# EasyEDA Pro project 电子指南针-git.eprj, board PCB6_2
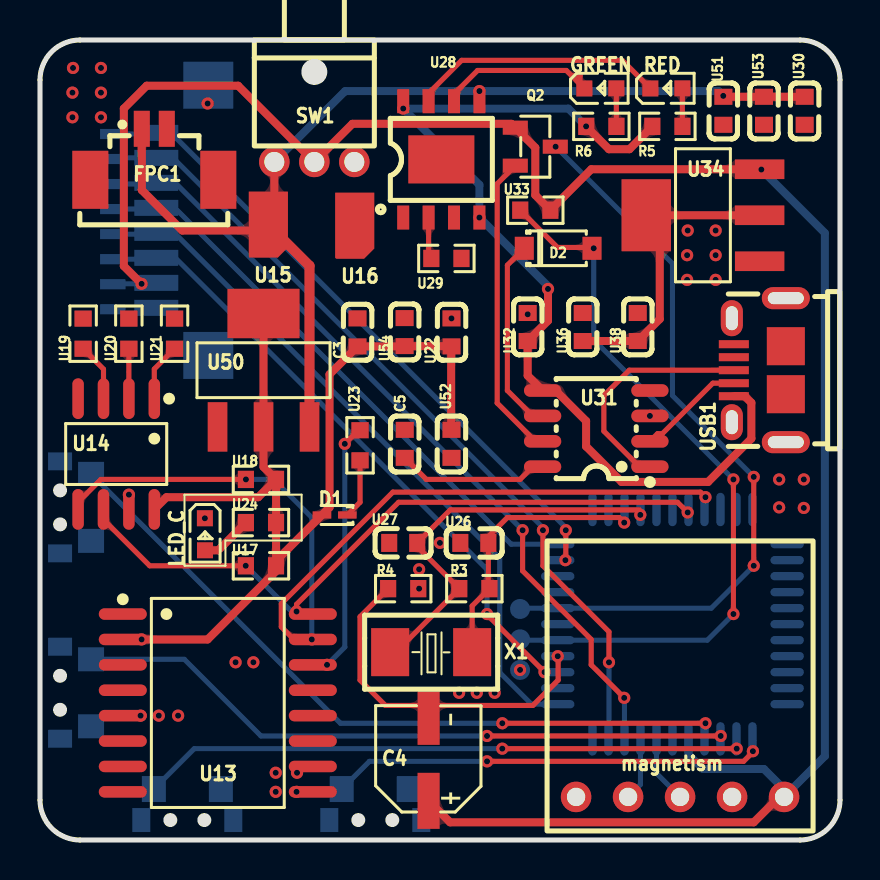
[diagram p4: board, top side]
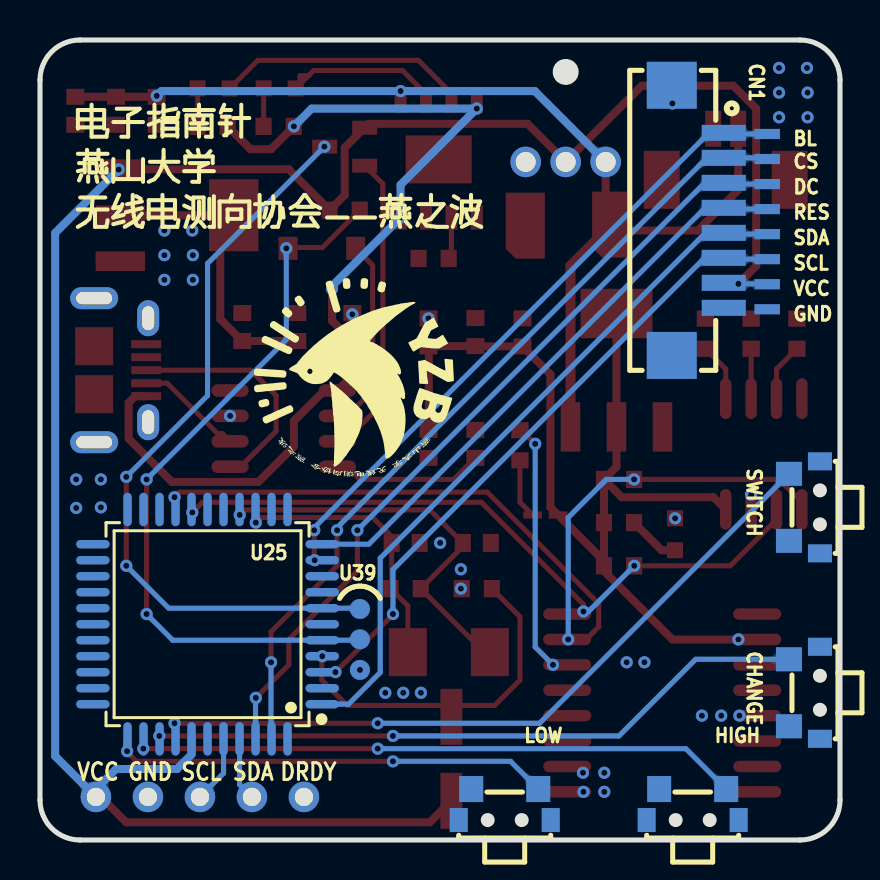
[diagram p5: board, bottom side, seen from below]

Outline 40 x 40 mm; copper layers: Top Layer, Bottom Layer. Coordinates in mm from the lower left corner of the outline.
Outline path: 0,38 0,2 arc(0.59,0.59) 2,0 38,0 arc(39.41,0.59) 40,2 40,38 arc(39.41,39.41) 38,40 2,40 arc(0.59,39.41) 0,38
Stack: Top Layer 0.035mm / Dielectric1 1.51mm FR4 er 4.5 / Bottom Layer 0.035mm

## Design rules (mm)
template: 自定义配置
spacing copperThickness1oz (default): track to track 0.102, other pairs 0.152 to 0.3
spacing copperThickness2oz: track to track 0.203, other pairs 0.152 to 0.3
track width copperThickness1oz (default): min 0.127, default 0.254, max 2.54
track width copperThickness2oz: min 0.203, default 0.254, max 2.54
differential pair differentialPair (default): width min 0.127, default 0.254, max 2.54; gap min 0.152, default 0.152
via viaSize (default): diameter min 0.5, default 0.61, max 10; hole min 0.3, default 0.305, max 6.3
net GND uses copperRegion1

## Placement (name value [footprint] x y rotation side)
BL  -  [mini焊盘]  3.64 35.3 180 bottom
C3  100nF  [C0603]  15.88 25.38 270 top
C4  10uF  [CAP-SMD_BD5.0-L5.3-W5.3-FD]  19.43 4.06 90 top
C5  100nF  [C0603]  18.24 19.81 90 top
CHANGE  TS24CA  [SW-SMD_TS24CA]  1.78 7.36 270 bottom
CN1  HC-1.25-8PWT  [CONN-SMD_HC-1.25-8PWT]  7.11 30.98 270 bottom
CS  -  [mini焊盘]  3.64 34.05 180 bottom
D1  1N4148WT  [SOD-523_L1.2-W0.8-LS1.6-RD]  14.73 16.25 180 top
D2  MBR0520  [SOD-123_L2.8-W1.8-LS3.7-RD]  25.91 29.59 0 top
DC  -  [mini焊盘]  3.64 32.8 180 bottom
FPC1  1.25-2PWB  [CONN-SMD_2P-P1.25_DEALON_1.25-2PWB]  5.72 34.28 0 top
GND  -  [mini焊盘]  3.64 26.54 180 bottom
GREEN  -  [LED_0603]  28.07 37.59 0 top
HIGH  TS24CA  [SW-SMD_TS24CA]  7.37 1.77 0 bottom
LED_C  -  [LED_0603]  8.25 15.23 270 top
LOW  TS24CA  [SW-SMD_TS24CA]  16.76 1.77 0 bottom
magnetism  -  [5插件焊盘 间距2.6mm]  32 2.15 0 top
Q2  2SK3018  [SOT-23-3_L2.9-W1.3-P1.90-LS2.4-BR]  24.76 34.67 180 top
R3  10K  [R0603]  21.72 12.57 0 top
R4  10K  [R0603]  18.16 12.57 180 top
R5  2kΩ  [R0603]  31.37 35.68 180 top
R6  2kΩ  [R0603]  28.07 35.68 180 top
RED  -  [LED_0603]  31.37 37.59 0 top
RES  -  [mini焊盘]  3.64 31.55 180 bottom
SCL  -  [mini焊盘]  3.64 29.04 180 bottom
SDA  -  [mini焊盘]  3.64 30.29 180 bottom
SW1  XKB5858-Z-C  [SW-TH_XKB5858-Z-C]  13.72 33.9 0 top
SWITCH  TS24CA  [SW-SMD_TS24CA]  1.78 16.63 270 bottom
U13  DS3231SN#  [SOIC-16_L10.3-W7.5-P1.27-LS10.3-BL]  8.89 6.85 270 top
U14  AT24C02  [SOP-8_L5.0-W4.0-P1.27-LS6.0-BL]  3.81 19.3 180 top
U15  -  [小焊盘]  11.38 31.15 180 top
U16  -  [小焊盘]  15.7 31.1 180 top
U17  4.7kΩ  [R0603]  11.05 13.71 0 top
U18  4.7kΩ  [R0603]  11.05 18.03 0 top
U19  4.7kΩ  [R0603]  2.16 25.32 90 top
U20  4.7kΩ  [R0603]  4.44 25.32 90 top
U21  4.7kΩ  [R0603]  6.73 25.32 90 top
U22  1uF  [C0603]  20.57 25.38 270 top
U23  200Ω  [R0603]  16 19.74 90 top
U24  1kΩ  [R0603]  11.05 15.87 0 top
U25  STC89C52RC-40I-LQFP44  [LQFP-44_L10.0-W10.0-P0.80-LS12.0-BL]  31.62 10.79 90 bottom
U26  30pF  [C0603]  21.72 14.85 0 top
U27  30pF  [C0603]  18.16 14.85 0 top
U28  TP4056  [ESOP-8_L4.9-W3.9-P1.27-LS6.0-BL-EP]  20.07 34.03 0 top
U29  1.2kΩ  [R0603]  20.32 29.08 180 top
U30  10uF  [C0603]  38.23 36.46 90 top
U31  CH340N  [SOP-8_L4.9-W3.9-P1.27-LS6.0-BL]  27.81 20.57 90 top
U32  10uF  [C0603]  24.38 25.65 270 top
U33  2kΩ  [R0603]  24.76 31.49 0 top
U34  SK12D07VG3  [SOT-223-4_L6.5-W3.5-P2.30-LS7.0-BR]  33.15 31.24 0 top
U36  10uF  [C0603]  27.14 25.65 270 top
U38  1.5pF  [C0603]  29.89 25.65 270 top
U39  -  [下载调试点]  24 11.04 180 bottom
U50  SK12D07VG3  [SOT-223-4_L6.5-W3.5-P2.30-LS7.0-BR]  11.18 23.49 270 top
U51  10uF  [C0603]  34.17 36.46 90 top
U52  10uF  [C0603]  20.57 19.81 90 top
U53  1.5pF  [C0603]  36.2 36.46 90 top
U54  1.5pF  [C0603]  18.23 25.39 270 top
USB1  U254-051N-4BH24-S2S  [MICRO-USB-SMD_U254-051N-4BH24-S2]  35.94 23.49 90 top
VCC  -  [mini焊盘]  3.64 27.79 180 bottom
X1  11.0592MHz  [OSC-SMD_L5.0-W3.2]  19.56 9.39 0 top

## Footprints (pads in the part's own frame, mm; a bottom-side part is the same pattern mirrored in y, then rotated)
5插件焊盘 间距2.6mm
  round 1.524 hole 0.914: 1(-5.2,0) 2(-2.6,0) 3(0,0) 4(2.6,0) 5(5.2,0)
C0603
  rect 0.8x0.9 smd: 1(-0.7,0) 2(0.7,0)
CAP-SMD_BD5.0-L5.3-W5.3-FD
  rect 2.8x1.1 smd: 1(-2.1,0) 2(2.1,0)
CONN-SMD_2P-P1.25_DEALON_1.25-2PWB
  rect 0.8x1.8 smd: 1(-0.625,1.275) 2(0.625,1.275)
  rect 1.8x2.9 smd: 3(-3.2,-1.275) 4(3.2,-1.275)
CONN-SMD_HC-1.25-8PWT
  rect 0.8x2.2 smd: 1(-4.375,1.3) 2(-3.125,1.3) 3(-1.875,1.3) 4(-0.625,1.3) 5(0.625,1.3) 6(1.875,1.3) 7(3.125,1.3) 8(4.375,1.3)
  rect 2.35x2.5 smd: 9(-6.755,-1.3) 10(6.755,-1.3)
ESOP-8_L4.9-W3.9-P1.27-LS6.0-BL-EP
  rect 0.6x1.2 smd: 1(-1.905,-2.909) 2(-0.635,-2.909) 3(0.635,-2.909) 4(1.905,-2.909) 5(1.905,2.909) 6(0.635,2.909) 7(-0.635,2.909) 8(-1.905,2.909)
  rect 3.3x2.4 smd: 9(0,0)
LED_0603
  rect 0.8x0.8 smd: 1(-0.851,-0.01) 2(0.75,-0.005)
LQFP-44_L10.0-W10.0-P0.80-LS12.0-BL
  oval 0.42x1.67 smd: 1(-4,-5.735) 2(-3.2,-5.735) 3(-2.4,-5.735) 4(-1.6,-5.735) 5(-0.8,-5.735) 6(0,-5.735) 7(0.8,-5.735) 8(1.6,-5.735) 9(2.4,-5.735) 10(3.2,-5.735) 11(4,-5.735) 23(4,5.735) 24(3.2,5.735) 25(2.4,5.735) 26(1.6,5.735) 27(0.8,5.735) 28(0,5.735) 29(-0.8,5.735) 30(-1.6,5.735) 31(-2.4,5.735) 32(-3.2,5.735) 33(-4,5.735)
  oval 1.67x0.42 smd: 12(5.735,-4) 13(5.735,-3.2) 14(5.735,-2.4) 15(5.735,-1.6) 16(5.735,-0.8) 17(5.735,0) 18(5.735,0.8) 19(5.735,1.6) 20(5.735,2.4) 21(5.735,3.2) 22(5.735,4) 34(-5.735,4) 35(-5.735,3.2) 36(-5.735,2.4) 37(-5.735,1.6) 38(-5.735,0.8) 39(-5.735,0) 40(-5.735,-0.8) 41(-5.735,-1.6) 42(-5.735,-2.4) 43(-5.735,-3.2) 44(-5.735,-4)
MICRO-USB-SMD_U254-051N-4BH24-S2
  rect 0.4x1.5 smd: 1(-1.3,1.25) 2(-0.65,1.25) 3(0,1.25) 4(0.65,1.25) 5(1.3,1.25)
  oval 1.1x2.4 hole 0.6x1.8: 6(-3.6,-1.35) 6(3.6,-1.35)
  oval 1.8x1.1 hole 1.2x0.6: 6(-2.6,1.35) 6(2.6,1.35)
  rect 1.9x1.9 smd: 6(-1.2,-1.35) 6(1.2,-1.35)
mini焊盘
  custom 1.27x0.508 smd: 1(0,0)
OSC-SMD_L5.0-W3.2
  rect 1.9x2.4 smd: 1(-2.05,0) 2(2.05,0)
R0603
  rect 0.806x0.864 smd: 1(-0.753,0) 2(0.753,0)
SOD-123_L2.8-W1.8-LS3.7-RD
  rect 0.95x1.15 smd: 1(-1.692,0) 2(1.692,0)
SOD-523_L1.2-W0.8-LS1.6-RD
  rect 0.93x0.36 smd: 1(-0.635,0) 2(0.635,0)
SOIC-16_L10.3-W7.5-P1.27-LS10.3-BL
  oval 0.574x2.401 smd: 1(-4.445,-4.75) 2(-3.175,-4.75) 3(-1.905,-4.75) 4(-0.635,-4.75) 5(0.635,-4.75) 6(1.905,-4.75) 7(3.175,-4.75) 8(4.445,-4.75) 9(4.445,4.75) 10(3.175,4.75) 11(1.905,4.75) 12(0.635,4.75) 13(-0.635,4.75) 14(-1.905,4.75) 15(-3.175,4.75) 16(-4.445,4.75)
SOP-8_L4.9-W3.9-P1.27-LS6.0-BL
  oval 0.63x1.865 smd: 1(-1.905,-2.683) 2(-0.635,-2.683) 3(0.635,-2.683) 4(1.905,-2.683) 5(1.905,2.683) 6(0.635,2.683) 7(-0.635,2.683) 8(-1.905,2.683)
SOP-8_L5.0-W4.0-P1.27-LS6.0-BL
  oval 0.574x2.035 smd: 1(-1.905,-2.768) 2(-0.635,-2.768) 3(0.635,-2.768) 4(1.905,-2.768) 5(1.905,2.768) 6(0.635,2.768) 7(-0.635,2.768) 8(-1.905,2.768)
SOT-23-3_L2.9-W1.3-P1.90-LS2.4-BR
  rect 1.25x0.7 smd: 1(1,-0.95) 2(1,0.95) 3(-1,0)
SOT-223-4_L6.5-W3.5-P2.30-LS7.0-BR
  rect 2.47x0.98 smd: 1(2.835,-2.3) 2(2.835,0) 3(2.835,2.3)
  rect 2.47x3.6 smd: 4(-2.835,0)
SW-SMD_TS24CA
  rect 0.9x1.2 smd: 1(-2.3,0.775) 2(2.3,0.775)
  rect 1.2x1.3 smd: 3(-1.675,-0.775) 4(1.675,-0.775)
SW-TH_XKB5858-Z-C
  round 1.524 hole 1: 1(2,0) 2(0,0) 3(-2,0)
下载调试点
  round 1 smd: 1(0,0.508) 2(0,-1.01) 3(0,-2.54)
小焊盘
  custom 1.957x3.302 smd: 1(-0.037,0.381)

## Nets
As in the schematic, except:
3V3: U34.2 U34.4 U36.2 U38.2
GND: C3.1 C5.2 CHANGE.4 CN1.8 CN1.9 CN1.10 FPC1.2 GND.1 HIGH.4 LED_C.1 LOW.4 magnetism.4 R4.1 SWITCH.4 U13.5 U13.6 U13.7 U13.8 U13.9 U13.10 U13.11 U13.12 U13.13 U14.4 U14.7 U16.1 U19.2 U20.2 U21.2 U22.1 U25.16 U26.1 U27.1 U28.1 U28.3 U28.9 U29.1 U30.1 U31.3 U32.1 U34.1 U36.1 U38.1 U39.3 U50.1 U51.1 U52.1 U53.1 U54.1 USB1.5 USB1.6
VCC: C4.1 CN1.7 magnetism.5 Q2.1 SW1.2 U25.38 U33.2 U34.3 VCC.1

Pads without a net: CHANGE 1 2; FPC1 3 4; HIGH 1 2; LOW 1 2; SW1 1; SWITCH 1 2; U13 1 3 4; U25 2 6 8 9 12 13 17 20 21 22 23 24 25 26 27 28 29 30 31 32 33 39 44; U31 4; USB1 4

## Via types
v1: diameter 0.61, hole 0.305, Top Layer to Bottom Layer, 80 vias

## Routing (per net, layer and track width the routed paths; a pad name or vN(x,y) marks a point on that pad's centre or on a via; arc(x,y) is an arc through that point)
3V3: length 15.4
  Top Layer w0.4: U36.2 U38.2 30.99,26.05 30.99,30.56 U34.4 U34.2
3V3_LONG: length 49.3
  Top Layer w0.254: 20.56,24.69 U22.2
  Top Layer w0.4: U50.4 U50.2 11.18,18.66 U18.2 ; 11.8,13.96 D1.2 14.48,16.63 14.48,23.28 C3.2 18.21,24.68 U54.2 20.56,24.69 20.56,20.52 U52.2 ; 11.8,13.96 U24.2 U18.2 ; 11.8,13.96 U17.2 11.8,13.45 8.38,10.03 v1(5.08,10.03) ; U18.2 10.91,17.14 6.32,17.14 U14.8
GND:
  vias: v1(1.65,38.6) v1(1.62,37.37) v1(1.62,36.13) v1(3.05,38.6) v1(3.05,37.37) v1(3.05,36.13) v1(4.44,17.27) v1(5.03,6.22) v1(5.94,6.22) v1(6.91,6.22) v1(8.24,16.09) v1(8.38,36.82) v1(9.78,8.88) v1(10.67,8.88) v1(11.79,3.36) v1(11.79,2.41) v1(12.85,3.36) v1(12.83,2.41) v1(18.96,13.54) v1(18.96,12.57) v1(20,14.86) v1(20.57,26.08) v1(20.95,7.36) v1(21.84,7.36) v1(22.73,7.36) v1(24,8.5) v1(24.38,26.28) v1(30.5,21.2) v1(32.36,29.24) v1(32.36,28.01) v1(32.38,30.47) v1(33.78,30.47) v1(33.78,29.24) v1(33.78,28.01) v1(36.96,18.03) v1(36.96,16.63) v1(38.19,18.03) v1(38.19,16.6)
VCC: length 109
  Top Layer w0.254: v1(36.07,33.52) 36.05,33.54 U34.3
  Top Layer w0.4: v1(5.08,27.81) 4.19,28.7 4.19,36.57 5.33,37.71 9.91,37.71 SW1.2 15.62,35.81 23.57,35.81 Q2.1 24.76,34.62 24.76,32.24 U33.2 27.56,33.54 U34.3 ; magnetism.5 36.96,2.15 35.69,0.88 20.51,0.88 C4.1
  Bottom Layer w0.254: VCC.1 3.66,27.81 v1(5.08,27.81) 5.13,27.86 CN1.7
  Bottom Layer w0.4: U25.38 32.42,4.27 33.15,3.55 36.19,3.55 37.2,2.54 magnetism.5 39.24,4.19 39.24,30.35 v1(36.07,33.52)
VCC_LONG: length 52.7
  Top Layer w0.4: FPC1.1 5.09,32.5 7.11,30.47 11.12,30.47 U15.1 11.72,31.07 SW1.3 ; U51.2 U53.2 U30.2
  Top Layer w0.5: U50.3 13.48,28.71 U15.1
  Bottom Layer w0.4: v1(34.16,37.21) 33.92,37.45 v1(21.97,37.45) 15.26,37.45 SW1.3
B_CHANGE: length 33.1
  Top Layer w0.254: v1(34.04,5.2) v1(22.35,5.2)
  Bottom Layer w0.254: v1(22.35,5.2) 11.05,5.2 7.22,9.04 CHANGE.3
B_HIGH: length 29.9
  Top Layer w0.254: 34.8,4.57 v1(23.11,4.57)
  Bottom Layer w0.254: v1(23.11,4.57) 7.71,4.57 HIGH.3
  vias: v1(34.83,4.57)
B_LOW: length 22
  Top Layer w0.254: 35.69,4.44 35.18,3.93 v1(22.35,3.93)
  Bottom Layer w0.254: U25.34 35.69,4.99 35.69,4.44 ; v1(22.35,3.93) 16.47,3.93 LOW.3
  vias: v1(35.64,4.44)
B_SWITCH: length 36.7
  Top Layer w0.254: v1(33.27,5.84) v1(23.11,5.84)
  Bottom Layer w0.254: U25.37 33.22,5.79 v1(33.27,5.84) ; SWITCH.3 15.02,5.84 v1(23.11,5.84)
BL_S: length 32.5
  Top Layer w0.254: v1(26.29,15.49) 26.29,14.01 v1(26.27,13.99)
  Bottom Layer w0.254: v1(26.29,15.49) 26.29,15.62 6.55,35.36 CN1.1 5.75,35.3 BL.1
CH_RXD: length 15.3
  Top Layer w0.254: U31.7 24.77,19.93 22.86,21.85 22.86,32.81 Q2.2
CH_TXD: length 9.8
  Top Layer w0.254: U31.6 24.64,21.2 23.37,22.47 23.37,28.74 D2.1
CS_S: length 41.1
  Top Layer w0.254: v1(25.15,15.49) 25.15,13.71 28.45,10.41 v1(28.45,8.88)
  Bottom Layer w0.254: CS.1 3.7,34.11 CN1.2 6.65,34.11 25.15,15.62 v1(25.15,15.49) ; v1(28.45,8.88) 28.45,5.08 U25.43
D+: length 11.8
  Top Layer w0.254: U31.1 29.97,18.66 28.19,20.44 28.19,22.22 29.46,23.49 USB1.3
D-: length 5.4
  Top Layer w0.254: U31.2 30.88,20.31 31.11,20.31 33.64,22.84 USB1.2
DC_S: length 40.3
  Top Layer w0.254: v1(24.13,15.49) 24.13,13.46 27.56,10.03 27.56,8.76 v1(29.21,7.11)
  Bottom Layer w0.254: v1(24.13,15.49) 6.76,32.86 CN1.3 5.75,32.8 DC.1 ; v1(29.21,7.11) 29.22,7.09 U25.42
LED_GREEN: length 8.6
  Top Layer w0.254: GREEN.1 27,37.79 ; 27,37.79 26.58,38.21 ; 27,37.79 27,38.21 26.58,38.21 ; 26.58,38.21 26.32,38.48 21.88,38.48 20.7,37.3 U28.6
LED_RED: length 12.7
  Top Layer w0.254: U28.7 19.43,37.33 21.08,38.98 29.11,38.98 RED.1
RES_S: length 29.2
  Bottom Layer w0.254: RES.1 5.75,31.55 CN1.4 6.74,31.61 23.56,14.79 U25.11
RXD: length 36.9
  Top Layer w0.254: v1(27.69,29.59) 27.64,29.63 27.6,29.63 ; 27.6,29.63 D2.2 ; 27.6,29.63 25.88,29.63 U33.1 ; v1(34.67,11.3) v1(34.67,18.03)
  Bottom Layer w0.254: v1(34.67,11.3) 33.36,9.99 U25.5 24.05,9.99 U39.2 ; v1(27.69,29.59) 27.69,25.01 v1(34.67,18.03)
SCL_C: length 34.3
  Top Layer w0.254: U14.6 3.17,16.02 5.49,13.71 U17.1 ; v1(32.38,16.38) 31.88,16.89 17.93,16.89 12.83,11.78 v1(12.83,11.42)
  Bottom Layer w0.254: v1(12.83,11.42) 12.57,11.42 v1(10.29,13.71)
SCL_M: length 3.4
  Bottom Layer w0.254: U25.40 30.82,3.33 magnetism.3
SCL_S: length 31.5
  Top Layer w0.254: v1(25.23,8.39) 22.35,11.27 v1(22.35,11.3)
  Bottom Layer w0.254: v1(22.35,11.3) 22.35,13.52 6.77,29.11 CN1.6 5.75,29.04 SCL.1
SDA_C: length 46
  Top Layer w0.254: U14.5 1.91,16.89 3.04,18.03 v1(10.3,18.03) ; U13.15 v1(13.59,10.03) 12.69,10.03 12.06,10.66 12.06,11.81 17.64,17.39 33.02,17.39 v1(33.27,17.14)
  Bottom Layer w0.254: v1(10.3,18.03) 11.68,18.03 13.59,16.12 v1(13.59,10.03)
SDA_M: length 3.2
  Bottom Layer w0.254: magnetism.2 30.02,2.77 U25.41
SDA_S: length 35.4
  Bottom Layer w0.254: SDA.1 5.75,30.29 CN1.5 6.72,30.36 22.99,14.09 22.99,8.38 24.57,6.79 U25.1
TXD: length 37.7
  Top Layer w0.254: v1(35.69,18.16) v1(35.69,13.71)
  Top Layer w0.4: v1(25.78,34.67) Q2.3
  Bottom Layer w0.254: v1(35.69,13.71) 33.57,11.59 U25.7 24.04,11.59 U39.1 ; v1(35.69,18.16) 31.62,22.22 31.62,28.82 v1(25.78,34.67)
VUSB: length 48.4
  Top Layer w0.4: USB1.1 35.24,22.19 35.57,21.86 35.57,20.07 33.4,17.9 29.08,17.9 27.3,19.68 27.3,20.95 25.78,22.47 U31.5 24.38,23.22 U32.2 25.4,25.96 v1(25.4,27.55) ; R5.2 29.47,34.54 28.45,34.54 v1(27.3,35.68) R6.2
  Bottom Layer w0.4: v1(25.4,27.55) 25.4,27.69 v1(21.97,31.12) 21.97,32.76 v1(18.16,36.57) 26.42,36.57 v1(27.3,35.68)
$1N3332: length 12.5
  Top Layer w0.254: v1(15.24,19.81) 15.92,20.49 16,20.49
  Bottom Layer w0.254: v1(14.35,8.76) 15.24,9.65 v1(15.24,19.81)
$1N3666: length 2.9
  Top Layer w0.254: U14.1 5.72,23.55 U21.1
$1N3668: length 2.9
  Top Layer w0.254: U19.1 3.17,23.54 U14.3
$1N3672: length 2.5
  Top Layer w0.254: U14.2 4.44,22.07 U20.1
$1N4126: length 3
  Top Layer w0.254: D1.1 16,16.89 U23.1
$1N4226: length 2.6
  Top Layer w0.4: U24.1 8.91,14.49 LED_C.2
$1N5582: length 13.5
  Top Layer w0.254: 22.42,12.52 U26.2 22.42,15.17 23.37,16.12 28.96,16.12 v1(29.21,15.87) ; X1.2 21.61,11.71 R3.2
$1N5600: length 19.8
  Top Layer w0.254: 29.97,16.5 20.51,16.5 U27.2 18.86,14.67 R3.1 17.79,9.39 X1.1
  Bottom Layer w0.254: 29.97,16.5 30,16.5 U25.15
  vias: v1(30.01,16.25)
$1N5639: length 17.3
  Top Layer w0.254: v1(25.89,9.19) 25.91,9.17 25.91,8 24.64,6.73 17.27,6.73 16,8 16,11.16 R4.2
$1N6255: length 2.1
  Top Layer w0.254: U29.2 19.43,29.21 U28.2
$1N6689: length 7.6
  Top Layer w0.254: 18.24,19.11 19.32,18.03 24,18.03 24.64,18.66 U31.8
$1N29996: length 1.9
  Top Layer w0.254: R5.1 32.12,35.69 RED.2
$1N30158: length 1.9
  Top Layer w0.254: GREEN.2 28.82,35.69 R6.1

## Copper pours and planes (outline as drawn; the poured copper is in the pictures)
GND on Top Layer: 0.13,40.13 40,40.13 40,0.12 0.13,0.12
GND on Bottom Layer: 0,40.25 40.26,40.25 40.26,-0.13 0,-0.13

Small or netless copper shapes (teardrops, artwork), in the pictures only: 141 on Top Layer, 79 on Bottom Layer

## Text on the board
Bottom Silkscreen Layer: DRDY | SDA | SCL | GND | VCC | 电子指南针 / 燕山大学 / 无线电测向协会——燕之波
